# EasyEDA Pro project ProProject_IMUSensorNodes202312.epro, board 6_6_拼板20240123（带编号） (continued)
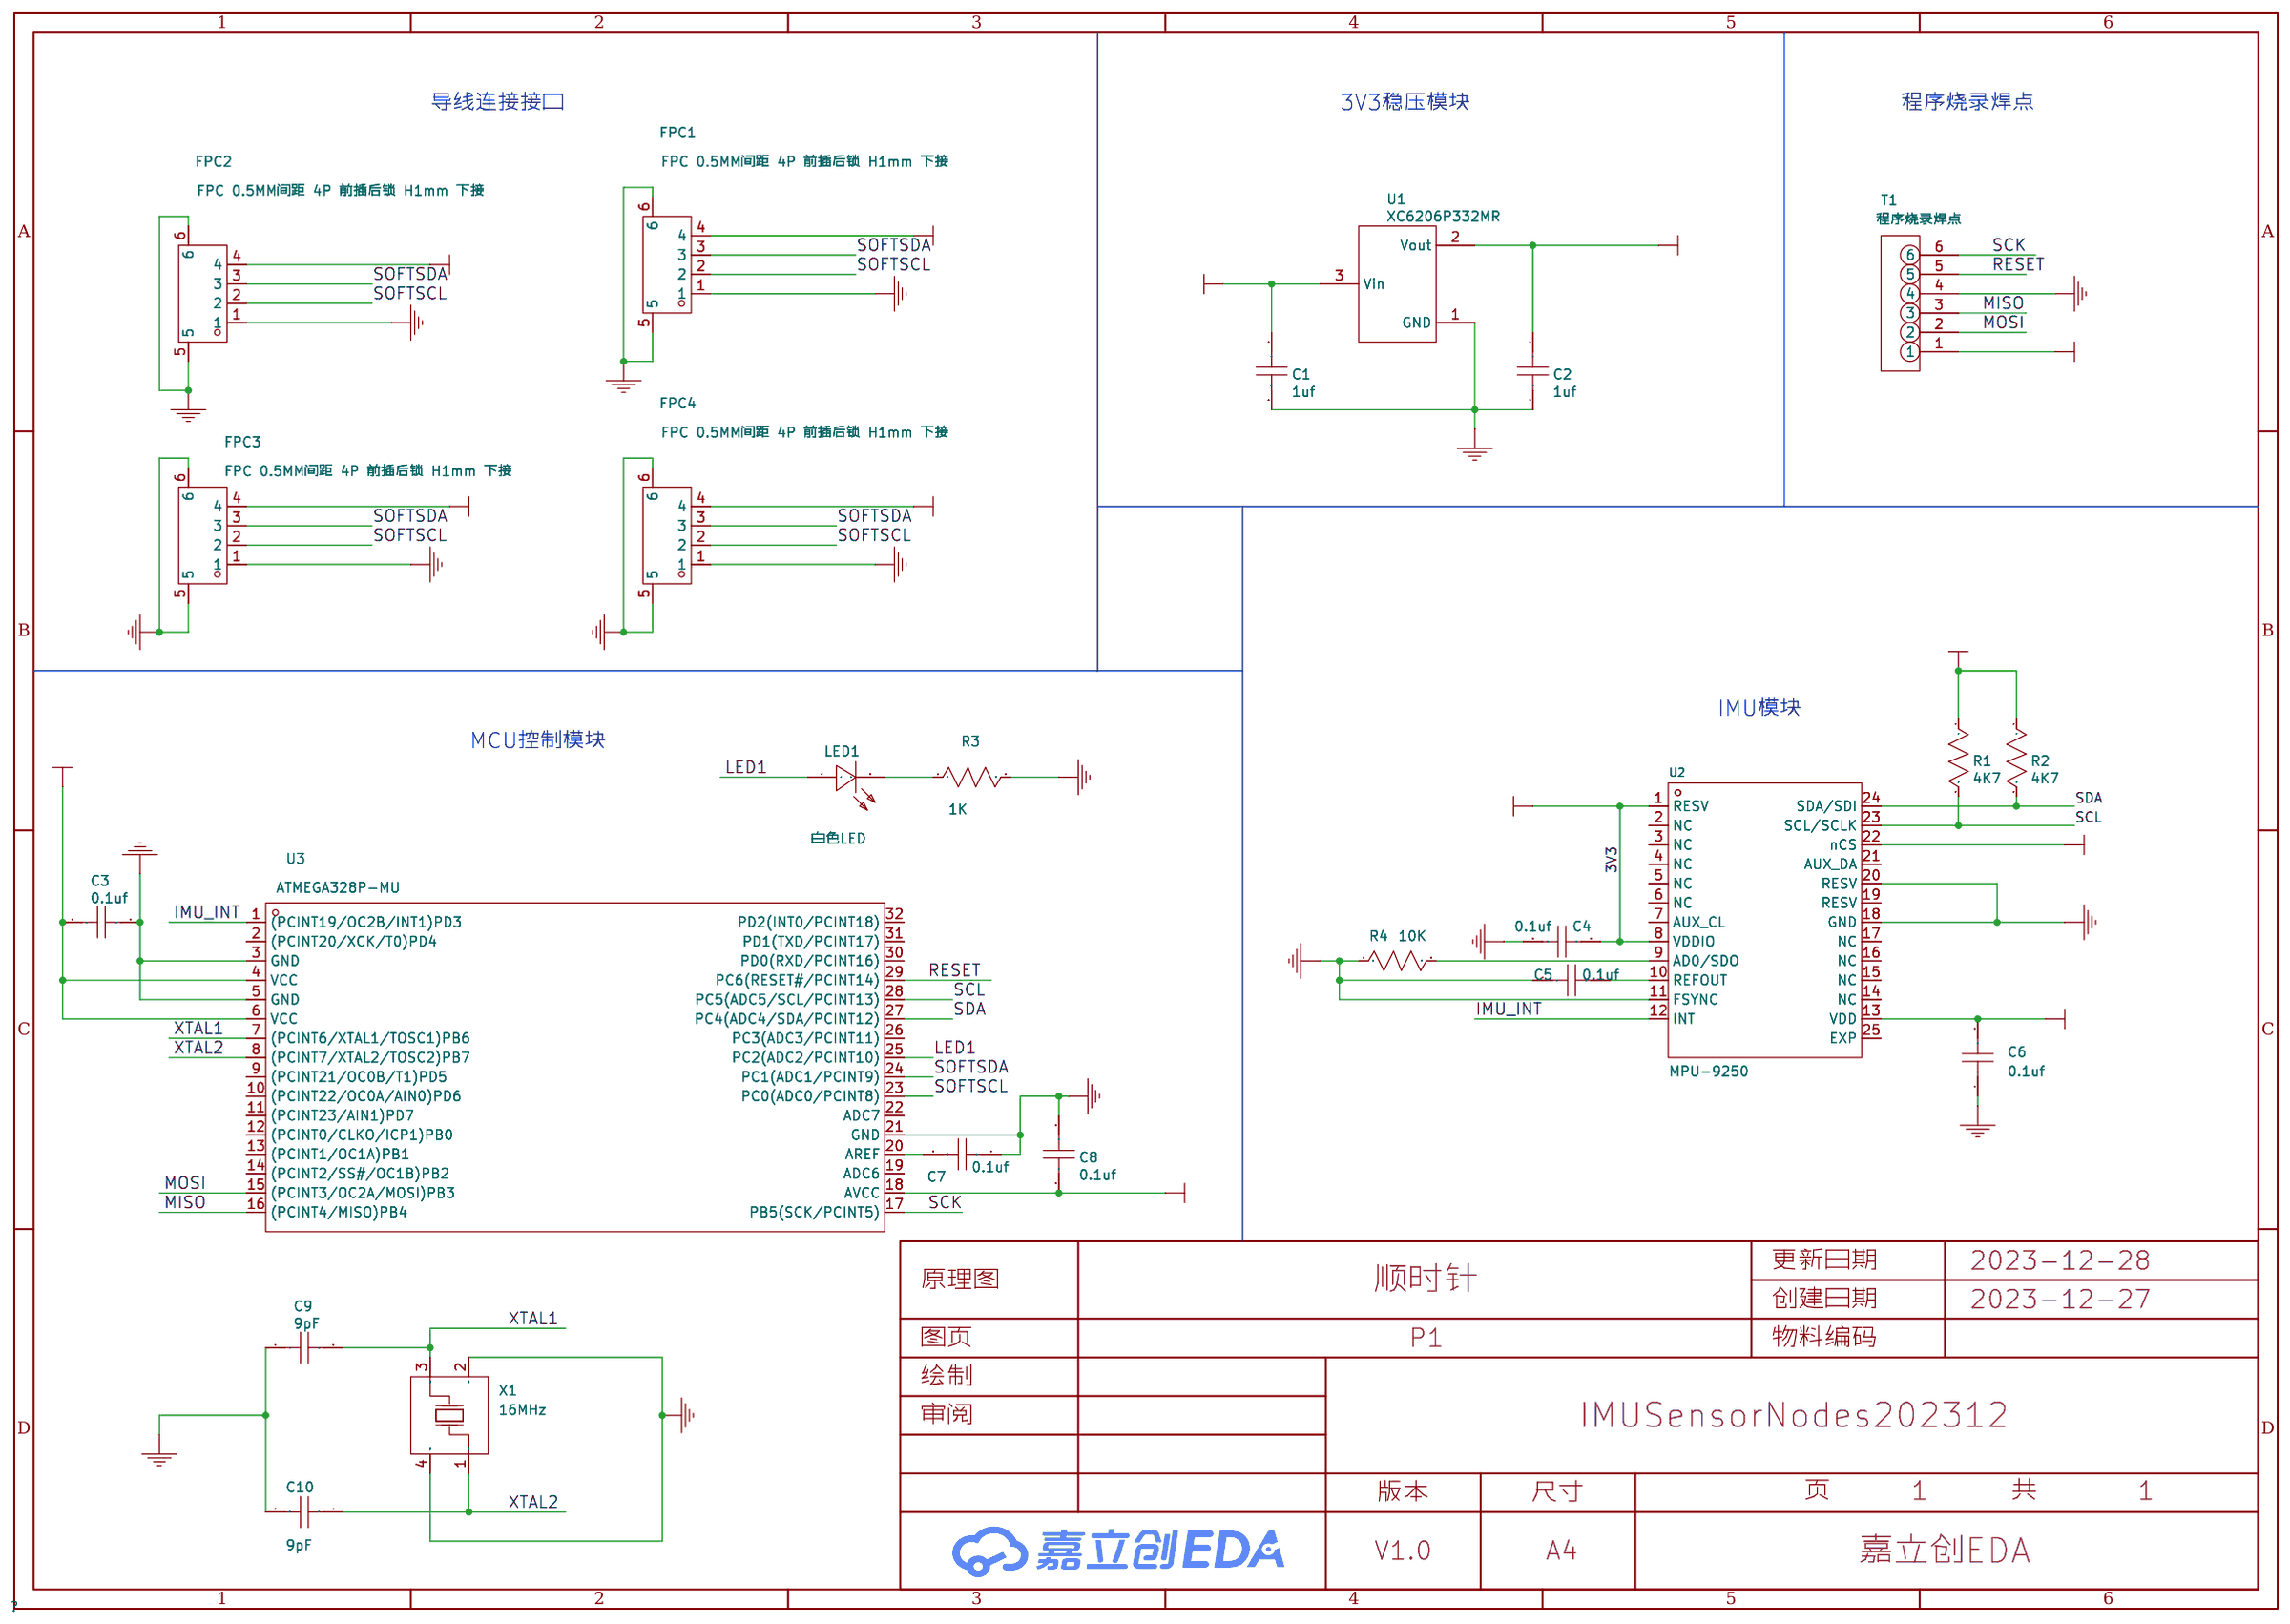
[diagram p0: schematic sheet]
## Placement (name value [footprint] x y rotation side) (continued)
Designator#913  -  [vqfn-32_l5.0-w5.0-p0.50-tl-ep3.1#2]  18.06 3.97 270 bottom
Designator#914  -  [test]  23.12 31.83 270 bottom
Designator#915  -  [qfn-24_l3.0-w3.0-p0.40-bl-ep]  18.32 64.29 0 bottom
Designator#916  -  [vqfn-32_l5.0-w5.0-p0.50-tl-ep3.1]  31.65 45.11 270 bottom
Designator#917  -  [vqfn-32_l5.0-w5.0-p0.50-tl-ep3.1]  4.35 3.97 270 bottom
Designator#918  -  [qfn-24_l3.0-w3.0-p0.40-bl-ep]  72.93 78.01 0 bottom
Designator#919  -  [qfn-24_l3.0-w3.0-p0.40-bl-ep#2]  59.21 36.86 0 bottom
Designator#920  -  [vqfn-32_l5.0-w5.0-p0.50-tl-ep3.1]  58.96 45.11 270 bottom
Designator#921  -  [qfn-24_l3.0-w3.0-p0.40-bl-ep#2]  31.91 36.86 0 bottom
Designator#922  -  [test]  23.12 18.11 270 bottom
Designator#923  -  [qfn-24_l3.0-w3.0-p0.40-bl-ep]  18.32 36.86 0 bottom
Designator#924  -  [test]  9.4 4.4 270 bottom

## Footprints (pads in the part's own frame, mm; a bottom-side part is the same pattern mirrored in y, then rotated)
C0201
  rect 0.28x0.318 smd: 1(-0.28,0) 2(0.28,0)
CRYSTAL-SMD_4P-L1.6-W1.2-BL
  rect 0.73x0.6 smd: 1(-0.55,-0.4) 2(0.55,-0.4) 3(0.55,0.4) 4(-0.55,0.4)
fpc-0.5mm-4p-h1.0
  rect 0.3x1 smd: 1(-0.75,0) 2(-0.251,0) 3(0.249,0) 4(0.75,0)
  rect 1x0.8 smd: 5(-1.81,-2.286)
  rect 1.2x0.8 smd: 6(1.794,-2.286)
fpc-0.5mm-4p-h1.0#2
  rect 0.3x1 smd: 1(-0.75,0) 2(-0.251,0) 3(0.249,0) 4(0.75,0)
  rect 1.2x0.8 smd: 5(-1.81,-2.286) 6(1.794,-2.286)
fpc-0.5mm-4p-h1.0#3
  rect 0.3x1 smd: 1(-0.75,0) 2(-0.251,0) 3(0.249,0) 4(0.75,0)
  rect 0.8x0.8 smd: 5(-1.81,-2.286) 6(1.794,-2.286)
LED0402
  rect 0.4x0.55 smd: 1(-0.45,0) 2(0.45,0)
qfn-24_l3.0-w3.0-p0.40-bl-ep
  custom 0.2x0.506 smd: 1(-1,-1.427) 6(1,-1.427) 13(1,1.427) 18(-1,1.427)
  rect 0.2x0.505 smd: 2(-0.6,-1.427) 3(-0.2,-1.427) 4(0.2,-1.427) 5(0.6,-1.427) 14(0.6,1.427) 15(0.2,1.427) 16(-0.2,1.427) 17(-0.6,1.427)
  rect 0.003x0.003 smd: 7(1.425,-0.997)
  rect 0.505x0.2 smd: 8(1.427,-0.6) 9(1.427,-0.2) 10(1.427,0.2) 11(1.427,0.6) 20(-1.427,0.6) 21(-1.427,0.2) 22(-1.427,-0.2) 23(-1.427,-0.6)
  custom 0.506x0.2 smd: 12(1.427,1) 19(-1.427,1) 24(-1.427,-1)
  rect 1.7x1.7 smd: 25(0,0)
qfn-24_l3.0-w3.0-p0.40-bl-ep#2
  custom 0.2x0.506 smd: 1(-1,-1.427) 6(1,-1.427) 13(1,1.427) 18(-1,1.427)
  rect 0.2x0.505 smd: 2(-0.6,-1.427) 3(-0.2,-1.427) 4(0.2,-1.427) 5(0.6,-1.427) 14(0.6,1.427) 15(0.2,1.427) 16(-0.2,1.427) 17(-0.6,1.427)
  rect 0.505x0.2 smd: 8(1.427,-0.6) 9(1.427,-0.2) 10(1.427,0.2) 11(1.427,0.6) 20(-1.427,0.6) 21(-1.427,0.2) 22(-1.427,-0.2) 23(-1.427,-0.6)
  custom 0.506x0.2 smd: 12(1.427,1) 19(-1.427,1) 24(-1.427,-1)
  rect 1.7x1.7 smd: 25(0,0)
R0201
  rect 0.28x0.318 smd: 1(-0.28,0) 2(0.28,0)
SOT-23-3_L2.9-W1.6-P1.90-LS2.8-BR
  rect 1.07x0.532 smd: 1(1.135,-0.95) 2(1.135,0.95) 3(-1.135,0)
test
  round 0.6 smd: 1(0,0) 2(1.27,0) 3(2.54,0) 4(0,-1.27) 5(1.27,-1.27) 6(2.54,-1.27)
vqfn-32_l5.0-w5.0-p0.50-tl-ep3.1
  rect 0.665x0.28 smd: 1(-2.408,1.75) 2(-2.408,1.25) 3(-2.408,0.75) 4(-2.408,0.25) 5(-2.408,-0.25) 6(-2.408,-0.75) 7(-2.408,-1.25) 8(-2.408,-1.75) 17(2.408,-1.75) 18(2.408,-1.25) 19(2.408,-0.75) 20(2.408,-0.25) 21(2.408,0.25) 23(2.408,1.25) 24(2.408,1.75)
  rect 0.28x0.665 smd: 10(-1.25,-2.408) 11(-0.75,-2.408) 12(-0.25,-2.408) 13(0.254,-2.413) 15(1.25,-2.408) 16(1.75,-2.408) 25(1.75,2.408) 27(0.75,2.408) 28(0.25,2.408) 29(-0.25,2.408) 32(-1.75,2.408)
  rect 0.003x0.003 smd: 13(0.25,-2.408)
  rect 3.1x3.1 smd: 33(0,0)
vqfn-32_l5.0-w5.0-p0.50-tl-ep3.1#2
  rect 0.665x0.28 smd: 1(-2.408,1.75) 2(-2.408,1.25) 3(-2.408,0.75) 4(-2.408,0.25) 5(-2.408,-0.25) 6(-2.408,-0.75) 7(-2.408,-1.25) 8(-2.408,-1.75) 17(2.408,-1.75) 18(2.408,-1.25) 19(2.408,-0.75) 20(2.408,-0.25) 21(2.408,0.25) 23(2.408,1.25) 24(2.408,1.75)
  rect 0.28x0.665 smd: 9(-1.75,-2.408) 10(-1.25,-2.408) 11(-0.75,-2.408) 12(-0.25,-2.408) 14(0.75,-2.408) 15(1.25,-2.408) 16(1.75,-2.408) 25(1.75,2.408) 27(0.75,2.408) 28(0.25,2.408) 29(-0.25,2.408) 31(-1.25,2.408) 32(-1.75,2.408)
  rect 3.1x3.1 smd: 33(0,0)
邮票孔
  round 0.3 hole 0.315x0.3: 1(0.508,2.54) 2(0.508,1.79) 3(0.508,1.04) 4(0.508,0.29) 5(0.508,-0.46) 6(0.508,-1.21) 7(0.508,-1.96) 8(0.508,-2.71) 9(-0.892,2.54) 10(-0.892,1.79) 11(-0.892,1.04) 12(-0.892,0.29) 13(-0.892,-0.46) 14(-0.892,-1.21) 15(-0.892,-1.96) 16(-0.892,-2.71)

## Nets
3V3: Designator#313.4 Designator#313.6 Designator#313.18 Designator#314.1 Designator#314.8 Designator#314.13 Designator#314.22 Designator#317.1 Designator#317.8 Designator#317.13 Designator#317.22 Designator#318.1 Designator#318.8 Designator#318.13 Designator#318.22 Designator#319.1 Designator#319.8 Designator#319.13 Designator#319.22 Designator#321.4 Designator#321.6 Designator#321.18 Designator#322.4 Designator#322.6 Designator#322.18 Designator#323.1 Designator#323.8 Designator#323.13 Designator#323.22 Designator#324.4 Designator#324.6 Designator#324.18 Designator#325.4 Designator#325.6 Designator#325.18 Designator#326.1 Designator#326.8 Designator#326.13 Designator#326.22 Designator#329.1 Designator#330.1 Designator#332.1 Designator#333.1 Designator#335.1 Designator#336.1 Designator#338.1 Designator#339.1 Designator#341.1 Designator#342.1 Designator#344.1 Designator#345.1 Designator#347.1 Designator#348.1 Designator#350.1 Designator#351.1 Designator#353.1 Designator#354.1 Designator#356.1 Designator#357.1 Designator#359.1 Designator#360.1 Designator#362.1 Designator#363.1 Designator#364.1 Designator#365.1 Designator#367.1 Designator#368.1 Designator#370.1 Designator#371.1 Designator#373.1 Designator#374.1 Designator#376.1 Designator#377.1 Designator#379.1 Designator#380.1 Designator#382.1 Designator#383.1 Designator#385.1 Designator#386.1 Designator#388.1 Designator#389.1 Designator#391.1 Designator#392.1 Designator#394.1 Designator#395.1 Designator#397.1 Designator#398.1 Designator#400.1 Designator#401.1 Designator#403.1 Designator#404.1 Designator#406.1 Designator#407.1 Designator#409.1 Designator#410.1 Designator#412.1 Designator#413.1 Designator#415.1 Designator#416.1 Designator#418.1 Designator#419.1 Designator#421.1 Designator#422.1 Designator#424.1 Designator#425.1 Designator#427.1 Designator#428.1 Designator#430.1 Designator#431.1 Designator#433.1 Designator#434.1 Designator#437.1 Designator#437.8 Designator#437.13 Designator#437.22 Designator#438.1 Designator#438.8 Designator#438.13 Designator#438.22 Designator#440.4 Designator#440.6 Designator#440.18 Designator#445.1 Designator#447.2 Designator#450.1 Designator#452.2 Designator#453.1 Designator#456.1 Designator#457.1 Designator#460.1 Designator#462.2 Designator#463.1 Designator#466.1 Designator#467.1 Designator#470.1 Designator#472.2 Designator#473.1 Designator#476.1 Designator#477.1 Designator#480.1 Designator#482.2 Designator#483.1 Designator#486.1 Designator#487.1 Designator#490.1 Designator#492.2 Designator#493.1 Designator#496.1 Designator#497.1 Designator#500.1 Designator#502.2 Designator#503.1 Designator#506.1 Designator#507.1 Designator#510.1 Designator#512.2 Designator#513.1 Designator#516.1 Designator#517.1 Designator#520.1 Designator#522.2 Designator#523.1 Designator#526.1 Designator#527.1 Designator#530.1 Designator#532.2 Designator#533.1 Designator#536.1 Designator#537.1 Designator#540.1 Designator#542.2 Designator#543.1 Designator#546.1 Designator#547.1 Designator#548.1 Designator#551.1 Designator#553.2 Designator#554.1 Designator#557.1 Designator#558.1 Designator#559.1 Designator#561.2 Designator#562.1 Designator#565.1 Designator#566.1 Designator#567.1 Designator#570.1 Designator#571.1 Designator#574.1 Designator#576.2 Designator#577.1 Designator#580.1 Designator#581.1 Designator#584.1 Designator#586.2 Designator#587.1 Designator#590.1 Designator#591.1 Designator#594.1 Designator#596.2 Designator#597.1 Designator#600.1 Designator#601.1 Designator#604.1 Designator#606.2 Designator#607.1 Designator#610.1 Designator#611.1 Designator#614.1 Designator#616.2 Designator#617.1 Designator#620.1 Designator#621.1 Designator#624.1 Designator#626.2 Designator#627.1 Designator#630.1 Designator#631.1 Designator#634.1 Designator#636.2 Designator#637.1 Designator#640.1 Designator#641.1 Designator#643.1 Designator#646.1 Designator#647.1 Designator#651.1 Designator#653.2 Designator#655.2 Designator#656.1 Designator#659.1 Designator#660.1 Designator#663.1 Designator#665.2 Designator#666.1 Designator#669.1 Designator#670.1 Designator#673.1 Designator#675.2 Designator#676.1 Designator#679.1 Designator#680.1 Designator#683.1 Designator#685.2 Designator#686.1 Designator#689.1 Designator#690.1 Designator#693.1 Designator#695.2 Designator#696.1 Designator#699.1 Designator#700.1 Designator#703.1 Designator#705.2 Designator#706.1 Designator#709.1 Designator#710.1 Designator#713.1 Designator#715.2 Designator#716.1 Designator#719.1 Designator#720.1 Designator#723.1 Designator#725.2 Designator#726.1 Designator#729.1 Designator#730.1 Designator#733.1 Designator#735.2 Designator#736.1 Designator#739.1 Designator#740.1 Designator#743.1 Designator#745.2 Designator#746.1 Designator#749.1 Designator#750.1 Designator#753.1 Designator#755.2 Designator#756.1 Designator#759.1 Designator#760.1 Designator#763.1 Designator#765.2 Designator#766.1 Designator#769.1 Designator#770.1 Designator#773.1 Designator#775.2 Designator#776.1 Designator#779.1 Designator#780.1 Designator#783.1 Designator#785.2 Designator#786.1 Designator#789.1 Designator#790.1 Designator#793.1 Designator#795.2 Designator#796.1 Designator#799.1 Designator#800.1 Designator#801.4 Designator#801.6 Designator#801.18 Designator#803.4 Designator#803.6 Designator#803.18 Designator#806.4 Designator#806.6 Designator#806.18 Designator#808.4 Designator#808.6 Designator#808.18 Designator#809.4 Designator#809.6 Designator#809.18 Designator#810.4 Designator#810.6 Designator#810.18 Designator#811.4 Designator#811.6 Designator#811.18 Designator#813.1 Designator#813.8 Designator#813.13 Designator#813.22 Designator#814.1 Designator#814.8 Designator#814.13 Designator#814.22 Designator#818.1 Designator#818.8 Designator#818.13 Designator#818.22 Designator#819.1 Designator#819.8 Designator#819.13 Designator#819.22 Designator#820.4 Designator#820.6 Designator#820.18 Designator#822.4 Designator#822.6 Designator#822.18 Designator#826.1 Designator#826.8 Designator#826.13 Designator#826.22 Designator#827.4 Designator#827.6 Designator#827.18 Designator#829.4 Designator#829.6 Designator#829.18 Designator#830.1 Designator#830.8 Designator#830.13 Designator#830.22 Designator#831.1 Designator#831.8 Designator#831.13 Designator#831.22 Designator#832.4 Designator#832.6 Designator#832.18 Designator#835.4 Designator#835.6 Designator#835.18 Designator#836.1 Designator#836.8 Designator#836.13 Designator#836.22 Designator#837.4 Designator#837.6 Designator#837.18 Designator#838.4 Designator#838.6 Designator#838.18 Designator#839.4 Designator#839.6 Designator#839.18 Designator#840.2 Designator#841.2 Designator#842.2 Designator#843.2 Designator#844.2 Designator#845.2 Designator#846.2 Designator#847.2 Designator#848.2 Designator#849.2 Designator#850.2 Designator#851.2 Designator#852.2 Designator#853.2 Designator#854.2 Designator#855.2 Designator#856.2 Designator#857.2 Designator#858.2 Designator#859.2 Designator#860.2 Designator#861.2 Designator#862.2 Designator#863.2 Designator#864.2 Designator#865.2 Designator#866.2 Designator#867.2 Designator#868.2 Designator#869.2 Designator#870.2 Designator#871.2 Designator#872.2 Designator#873.2 Designator#874.2 Designator#875.2 Designator#877.1 Designator#877.8 Designator#877.13 Designator#877.22 Designator#878.1 Designator#878.8 Designator#878.13 Designator#878.22 Designator#880.1 Designator#880.8 Designator#880.13 Designator#880.22 Designator#881.1 Designator#881.8 Designator#881.13 Designator#881.22 Designator#882.1 Designator#882.8 Designator#882.13 Designator#882.22 Designator#883.1 Designator#883.8 Designator#883.13 Designator#883.22 Designator#885.4 Designator#885.6 Designator#885.18 Designator#886.1 Designator#886.8 Designator#886.13 Designator#886.22 Designator#888.1 Designator#888.8 Designator#888.13 Designator#888.22 Designator#889.4 Designator#889.6 Designator#889.18 Designator#890.1 Designator#890.8 Designator#890.13 Designator#890.22 Designator#892.4 Designator#892.6 Designator#892.18 Designator#895.4 Designator#895.6 Designator#895.18 Designator#896.4 Designator#896.6 Designator#896.18 Designator#897.1 Designator#897.8 Designator#897.13 Designator#897.22 Designator#900.1 Designator#900.8 Designator#900.13 Designator#900.22 Designator#901.1 Designator#901.8 Designator#901.13 Designator#901.22 Designator#902.4 Designator#902.6 Designator#902.18 Designator#903.4 Designator#903.6 Designator#903.18 Designator#904.4 Designator#904.6 Designator#904.18 Designator#906.4 Designator#906.6 Designator#906.18 Designator#909.1 Designator#909.8 Designator#909.13 Designator#909.22 Designator#910.4 Designator#910.6 Designator#910.18 Designator#911.1 Designator#911.8 Designator#911.13 Designator#911.22 Designator#912.1 Designator#912.8 Designator#912.13 Designator#912.22 Designator#913.4 Designator#913.6 Designator#913.18 Designator#915.1 Designator#915.8 Designator#915.13 Designator#915.22 Designator#916.4 Designator#916.6 Designator#916.18 Designator#917.4 Designator#917.6 Designator#917.18 Designator#918.1 Designator#918.8 Designator#918.13 Designator#918.22 Designator#919.1 Designator#919.8 Designator#919.13 Designator#919.22 Designator#920.4 Designator#920.6 Designator#920.18 Designator#921.1 Designator#921.8 Designator#921.13 Designator#921.22 Designator#923.1 Designator#923.8 Designator#923.13 Designator#923.22
5V: Designator.4 Designator#2.1 Designator#3.4 Designator#4.1 Designator#5.4 Designator#6.4 Designator#7.4 Designator#8.4 Designator#9.1 Designator#10.4 Designator#11.4 Designator#12.1 Designator#13.1 Designator#14.4 Designator#15.4 Designator#16.4 Designator#17.1 Designator#18.4 Designator#19.1 Designator#20.1 Designator#81.1 Designator#82.1 Designator#83.1 Designator#84.1 Designator#85.4 Designator#86.4 Designator#87.1 Designator#88.4 Designator#89.1 Designator#90.1 Designator#91.1 Designator#92.4 Designator#93.4 Designator#94.4 Designator#95.1 Designator#96.4 Designator#97.1 Designator#98.4 Designator#99.4 Designator#100.1 Designator#101.4 Designator#102.1 Designator#103.1 Designator#104.1 Designator#105.4 Designator#106.1 Designator#107.4 Designator#108.1 Designator#109.1 Designator#146.1 Designator#147.1 Designator#148.4 Designator#149.1 Designator#150.4 Designator#151.4 Designator#152.1 Designator#153.1 Designator#154.1 Designator#155.1 Designator#156.4 Designator#157.4 Designator#158.1 Designator#159.4 Designator#160.1 Designator#161.4 Designator#162.1 Designator#163.4 Designator#164.1 Designator#165.1 Designator#166.4 Designator#167.1 Designator#168.1 Designator#169.4 Designator#170.1 Designator#171.1 Designator#172.1 Designator#173.1 Designator#174.1 Designator#175.4 Designator#176.1 Designator#177.1 Designator#214.4 Designator#215.4 Designator#216.1 Designator#217.4 Designator#218.4 Designator#219.4 Designator#220.1 Designator#221.4 Designator#222.4 Designator#223.4 Designator#224.4 Designator#225.4 Designator#226.1 Designator#227.1 Designator#228.1 Designator#229.1 Designator#230.4 Designator#231.4 Designator#232.1 Designator#233.4 Designator#234.4 Designator#235.1 Designator#236.4 Designator#237.4 Designator#238.4 Designator#239.4 Designator#240.4 Designator#241.1 Designator#242.1 Designator#243.4 Designator#244.1 Designator#245.1 Designator#282.1 Designator#283.4 Designator#284.1 Designator#285.1 Designator#286.1 Designator#287.1 Designator#288.1 Designator#289.1 Designator#290.4 Designator#291.4 Designator#292.4 Designator#293.4 Designator#294.4 Designator#295.1 Designator#296.1 Designator#297.4 Designator#298.4 Designator#299.4 Designator#300.4 Designator#301.4 Designator#302.4 Designator#303.4 Designator#304.1 Designator#305.1 Designator#306.1 Designator#307.1 Designator#308.4 Designator#309.4 Designator#310.1 Designator#311.4 Designator#312.4 Designator#315.1 Designator#316.1 Designator#320.1 Designator#327.1 Designator#436.1 Designator#439.1 Designator#454.1 Designator#464.1 Designator#474.1 Designator#484.1 Designator#494.1 Designator#504.1 Designator#514.1 Designator#524.1 Designator#534.1 Designator#544.1 Designator#555.1 Designator#563.1 Designator#568.1 Designator#578.1 Designator#588.1 Designator#598.1 Designator#608.1 Designator#618.1 Designator#628.1 Designator#638.1 Designator#644.1 Designator#657.1 Designator#667.1 Designator#677.1 Designator#687.1 Designator#697.1 Designator#707.1 Designator#717.1 Designator#727.1 Designator#737.1 Designator#747.1 Designator#757.1 Designator#767.1 Designator#777.1 Designator#787.1 Designator#797.1 Designator#802.1 Designator#804.1 Designator#805.1 Designator#807.1 Designator#812.1 Designator#815.1 Designator#816.1 Designator#817.1 Designator#821.1 Designator#823.1 Designator#824.1 Designator#825.1 Designator#828.1 Designator#833.1 Designator#834.1 Designator#840.3 Designator#841.3 Designator#842.3 Designator#843.3 Designator#844.3 Designator#845.3 Designator#846.3 Designator#847.3 Designator#848.3 Designator#849.3 Designator#850.3 Designator#851.3 Designator#852.3 Designator#853.3 Designator#854.3 Designator#855.3 Designator#856.3 Designator#857.3 Designator#858.3 Designator#859.3 Designator#860.3 Designator#861.3 Designator#862.3 Designator#863.3 Designator#864.3 Designator#865.3 Designator#866.3 Designator#867.3 Designator#868.3 Designator#869.3 Designator#870.3 Designator#871.3 Designator#872.3 Designator#873.3 Designator#874.3 Designator#875.3 Designator#876.1 Designator#879.1 Designator#884.1 Designator#887.1 Designator#891.1 Designator#893.1 Designator#894.1 Designator#898.1 Designator#899.1 Designator#905.1 Designator#907.1 Designator#908.1 Designator#914.1 Designator#922.1 Designator#924.1
GND: Designator.1 Designator.5 Designator.6 Designator#2.4 Designator#2.5 Designator#2.6 Designator#3.1 Designator#3.5 Designator#3.6 Designator#4.4 Designator#4.5 Designator#4.6 Designator#5.1 Designator#5.5 Designator#5.6 Designator#6.1 Designator#6.5 Designator#6.6 Designator#7.1 Designator#8.1 Designator#9.4 Designator#9.5 Designator#9.6 Designator#10.1 Designator#11.1 Designator#11.5 Designator#11.6 Designator#12.4 Designator#12.5 Designator#12.6 Designator#13.4 Designator#13.5 Designator#13.6 Designator#14.1 Designator#14.5 Designator#14.6 Designator#15.1 Designator#15.5 Designator#15.6 Designator#16.1 Designator#17.4 Designator#17.5 Designator#17.6 Designator#18.1 Designator#18.5 Designator#18.6 Designator#19.4 Designator#20.4 Designator#20.5 Designator#20.6 Designator#81.4 Designator#81.5 Designator#81.6 Designator#82.4 Designator#82.5 Designator#82.6 Designator#83.4 Designator#83.5 Designator#83.6 Designator#84.4 Designator#84.5 Designator#84.6 Designator#85.1 Designator#86.1 Designator#86.5 Designator#86.6 Designator#87.4 Designator#87.5 Designator#87.6 Designator#88.1 Designator#89.4 Designator#90.4 Designator#91.4 Designator#91.5 Designator#91.6 Designator#92.1 Designator#92.5 Designator#92.6 Designator#93.1 Designator#93.5 Designator#93.6 Designator#94.1 Designator#94.5 Designator#94.6 Designator#95.4 Designator#95.5 Designator#95.6 Designator#96.1 Designator#97.4 Designator#97.5 Designator#97.6 Designator#98.1 Designator#98.5 Designator#98.6 Designator#99.1 Designator#99.5 Designator#99.6 Designator#100.4 Designator#100.5 Designator#100.6 Designator#101.1 Designator#102.4 Designator#103.4 Designator#103.5 Designator#103.6 Designator#104.4 Designator#104.5 Designator#104.6 Designator#105.1 Designator#106.4 Designator#106.5 Designator#106.6 Designator#107.1 Designator#108.4 Designator#109.4 Designator#109.5 Designator#109.6 Designator#110.2 Designator#110.4 Designator#111.2 Designator#111.4 Designator#112.2 Designator#112.4 Designator#113.2 Designator#113.4 Designator#114.2 Designator#114.4 Designator#115.2 Designator#115.4 Designator#116.2 Designator#116.4 Designator#117.2 Designator#117.4 Designator#118.2 Designator#118.4 Designator#119.2 Designator#119.4 Designator#120.2 Designator#120.4 Designator#121.2 Designator#121.4 Designator#122.2 Designator#122.4 Designator#123.2 Designator#123.4 Designator#124.2 Designator#124.4 Designator#125.2 Designator#125.4 Designator#126.2 Designator#126.4 Designator#127.2 Designator#127.4 Designator#128.2 Designator#128.4 Designator#129.2 Designator#129.4 Designator#130.2 Designator#130.4 Designator#131.2 Designator#131.4 Designator#132.2 Designator#132.4 Designator#133.2 Designator#133.4 Designator#134.2 Designator#134.4 Designator#135.2 Designator#135.4 Designator#136.2 Designator#136.4 Designator#137.2 Designator#137.4 Designator#138.2 Designator#138.4 Designator#139.2 Designator#139.4 Designator#140.2 Designator#140.4 Designator#141.2 Designator#141.4 Designator#142.2 Designator#142.4 Designator#143.2 Designator#143.4 Designator#144.2 Designator#144.4 Designator#145.2 Designator#145.4 Designator#146.4 Designator#146.5 Designator#146.6 Designator#147.4 Designator#147.5 Designator#147.6 Designator#148.1 Designator#148.5 Designator#148.6 Designator#149.4 Designator#150.1 Designator#150.5 Designator#150.6 Designator#151.1 Designator#151.5 Designator#151.6 Designator#152.4 Designator#152.5 Designator#152.6 Designator#153.4 Designator#154.4 Designator#155.4 Designator#155.5 Designator#155.6 Designator#156.1 Designator#156.5 Designator#156.6 Designator#157.1 Designator#157.5 Designator#157.6 Designator#158.4 Designator#158.5 Designator#158.6 Designator#159.1 Designator#159.5 Designator#159.6 Designator#160.4 Designator#160.5 Designator#160.6 Designator#161.1 Designator#162.4 Designator#162.5 Designator#162.6 Designator#163.1 Designator#164.4 Designator#164.5 Designator#164.6 Designator#165.4 Designator#165.5 Designator#165.6 Designator#166.1 Designator#166.5 Designator#166.6 Designator#167.4 Designator#167.5 Designator#167.6 Designator#168.4 Designator#168.5 Designator#168.6 Designator#169.1 Designator#169.5 Designator#169.6 Designator#170.4 Designator#170.5 Designator#170.6 Designator#171.4 Designator#171.5 Designator#171.6 Designator#172.4 Designator#173.4 Designator#173.5 Designator#173.6 Designator#174.4 Designator#175.1 Designator#175.5 Designator#175.6 Designator#176.4 Designator#176.5 Designator#176.6 Designator#177.4 Designator#178.2 Designator#179.2 Designator#180.2 Designator#181.2 Designator#182.2 Designator#183.2 Designator#184.2 Designator#185.2 Designator#186.2 Designator#187.2 Designator#188.2 Designator#189.2 Designator#190.2 Designator#191.2 Designator#192.2 Designator#193.2 Designator#194.2 Designator#195.2 Designator#196.2 Designator#197.2 Designator#198.2 Designator#199.2 Designator#200.2 Designator#201.2 Designator#202.2 Designator#203.2 Designator#204.2 Designator#205.2 Designator#206.2 Designator#207.2 Designator#208.2 Designator#209.2 Designator#210.2 Designator#211.2 Designator#212.2 Designator#213.2 Designator#214.1 Designator#214.5 Designator#214.6 Designator#215.1 Designator#215.5 Designator#215.6 Designator#216.4 Designator#217.1 Designator#217.5 Designator#217.6 Designator#218.1 Designator#218.5 Designator#218.6 Designator#219.1 Designator#219.5 Designator#219.6 Designator#220.4 Designator#220.5 Designator#220.6 Designator#221.1 Designator#221.5 Designator#221.6 Designator#222.1 Designator#223.1 Designator#224.1 Designator#225.1 Designator#225.5 Designator#225.6 Designator#226.4 Designator#226.5 Designator#226.6 Designator#227.4 Designator#228.4 Designator#228.5 Designator#228.6 Designator#229.4 Designator#229.5 Designator#229.6 Designator#230.1 Designator#230.5 Designator#230.6 Designator#231.1 Designator#231.5 Designator#231.6 Designator#232.4 Designator#232.5 Designator#232.6 Designator#233.1 Designator#233.5 Designator#233.6 Designator#234.1 Designator#234.5 Designator#234.6 Designator#235.4 Designator#235.5 Designator#235.6 Designator#236.1 Designator#237.1 Designator#237.5 Designator#237.6 Designator#238.1 Designator#238.5 Designator#238.6 Designator#239.1 Designator#239.5 Designator#239.6 Designator#240.1 Designator#241.4 Designator#241.5 Designator#241.6 Designator#242.4 Designator#243.1 Designator#243.5 Designator#243.6 Designator#244.4 Designator#244.5 Designator#244.6 Designator#245.4 Designator#282.4 Designator#282.5 Designator#282.6 Designator#283.1 Designator#283.5 Designator#283.6 Designator#284.4 Designator#284.5 Designator#284.6 Designator#285.4 Designator#286.4 Designator#286.5 Designator#286.6 Designator#287.4 Designator#287.5 Designator#287.6 Designator#288.4 Designator#288.5 Designator#288.6 Designator#289.4 Designator#289.5 Designator#289.6 Designator#290.1 Designator#290.5 Designator#290.6 Designator#291.1 Designator#291.5 Designator#291.6 Designator#292.1 Designator#292.5 Designator#292.6 Designator#293.1 Designator#294.1 Designator#294.5 Designator#294.6 Designator#295.4 Designator#296.4 Designator#296.5 Designator#296.6 Designator#297.1 Designator#297.5 Designator#297.6 Designator#298.1 Designator#298.5 Designator#298.6 Designator#299.1 Designator#299.5 Designator#299.6 Designator#300.1 Designator#300.5 Designator#300.6 Designator#301.1 Designator#301.5 Designator#301.6 Designator#302.1 Designator#302.5 Designator#302.6 Designator#303.1 Designator#303.5 Designator#303.6 Designator#304.4 Designator#304.5 Designator#304.6 Designator#305.4 Designator#305.5 Designator#305.6 Designator#306.4 Designator#307.4 Designator#307.5 Designator#307.6 Designator#308.1 Designator#308.5 Designator#308.6 Designator#309.1 Designator#309.5 Designator#309.6 Designator#310.4 Designator#310.5 Designator#310.6 Designator#311.1 Designator#311.5 Designator#311.6 Designator#312.1 Designator#312.5 Designator#312.6 Designator#313.3 Designator#313.5 Designator#313.21 Designator#313.33 Designator#314.11 Designator#314.18 Designator#314.20 Designator#314.25 Designator#315.4 Designator#316.4 Designator#317.11 Designator#317.18 Designator#317.20 Designator#317.25 Designator#318.11 Designator#318.18 Designator#318.20 Designator#318.25 Designator#319.11 Designator#319.18 Designator#319.20 Designator#319.25 Designator#320.4 Designator#321.3 Designator#321.5 Designator#321.21 Designator#321.33 Designator#322.3 Designator#322.5 Designator#322.21 Designator#322.33 Designator#323.11 Designator#323.18 Designator#323.20 Designator#323.25 Designator#324.3 Designator#324.5 Designator#324.21 Designator#324.33 Designator#325.3 Designator#325.5 Designator#325.21 Designator#325.33 Designator#326.11 Designator#326.18 Designator#326.20 Designator#326.25 Designator#327.4 Designator#328.1 Designator#331.1 Designator#334.1 Designator#337.1 Designator#340.1 Designator#343.1 Designator#346.1 Designator#349.1 Designator#352.1 Designator#355.1 Designator#358.1 Designator#361.1 Designator#366.1 Designator#369.1 Designator#372.1 Designator#375.1 Designator#378.1 Designator#381.1 Designator#384.1 Designator#387.1 Designator#390.1 Designator#393.1 Designator#396.1 Designator#399.1 Designator#402.1 Designator#405.1 Designator#408.1 Designator#411.1 Designator#414.1 Designator#417.1 Designator#420.1 Designator#423.1 Designator#426.1 Designator#429.1 Designator#432.1 Designator#435.1 Designator#436.4 Designator#437.11 Designator#437.18 Designator#437.20 Designator#437.25 Designator#438.11 Designator#438.18 Designator#438.20 Designator#438.25 Designator#439.4 Designator#440.3 Designator#440.5 Designator#440.21 Designator#440.33 Designator#441.2 Designator#442.1 Designator#443.2 Designator#444.1 Designator#445.2 Designator#446.1 Designator#447.1 Designator#448.2 Designator#449.1 Designator#450.2 Designator#451.1 Designator#452.1 Designator#453.2 Designator#454.2 Designator#455.1 Designator#456.2 Designator#457.2 Designator#458.2 Designator#459.1 Designator#460.2 Designator#461.1 Designator#462.1 Designator#463.2 Designator#464.2 Designator#465.1 Designator#466.2 Designator#467.2 Designator#468.2 Designator#469.1 Designator#470.2 Designator#471.1 Designator#472.1 Designator#473.2 Designator#474.2 Designator#475.1 Designator#476.2 Designator#477.2 Designator#478.2 Designator#479.1 Designator#480.2 Designator#481.1 Designator#482.1 Designator#483.2 Designator#484.2 Designator#485.1 Designator#486.2 Designator#487.2 Designator#488.2 Designator#489.1 Designator#490.2 Designator#491.1 Designator#492.1 Designator#493.2 Designator#494.2 Designator#495.1 Designator#496.2 Designator#497.2 Designator#498.2 Designator#499.1 Designator#500.2 Designator#501.1 Designator#502.1 Designator#503.2 Designator#504.2 Designator#505.1 Designator#506.2 Designator#507.2 Designator#508.2 Designator#509.1 Designator#510.2 Designator#511.1 Designator#512.1 Designator#513.2 Designator#514.2 Designator#515.1 Designator#516.2 Designator#517.2 Designator#518.2 Designator#519.1 Designator#520.2 Designator#521.1 Designator#522.1 Designator#523.2 Designator#524.2 Designator#525.1 Designator#526.2 Designator#527.2 Designator#528.2 Designator#529.1 Designator#530.2 Designator#531.1 Designator#532.1 Designator#533.2 Designator#534.2 Designator#535.1 Designator#536.2 Designator#537.2 Designator#538.2 Designator#539.1 Designator#540.2 Designator#541.1 Designator#542.1 Designator#543.2 Designator#544.2 Designator#545.1 Designator#546.2 Designator#547.2 Designator#548.2 Designator#549.2 Designator#550.1 Designator#551.2 Designator#552.1 Designator#553.1 Designator#554.2 Designator#555.2 Designator#556.1 Designator#557.2 Designator#558.2 Designator#559.2 Designator#560.1 Designator#561.1 Designator#562.2 Designator#563.2 Designator#564.1 Designator#565.2 Designator#566.2 Designator#567.2 Designator#568.2 Designator#569.1 Designator#570.2 Designator#571.2 Designator#572.2 Designator#573.1 Designator#574.2 Designator#575.1 Designator#576.1 Designator#577.2 Designator#578.2 Designator#579.1 Designator#580.2 Designator#581.2 Designator#582.2 Designator#583.1 Designator#584.2 Designator#585.1 Designator#586.1 Designator#587.2 Designator#588.2 Designator#589.1 Designator#590.2 Designator#591.2 Designator#592.2 Designator#593.1 Designator#594.2 Designator#595.1 Designator#596.1 Designator#597.2 Designator#598.2 Designator#599.1 Designator#600.2 Designator#601.2 Designator#602.2 Designator#603.1 Designator#604.2 Designator#605.1 Designator#606.1 Designator#607.2 Designator#608.2 Designator#609.1 Designator#610.2 Designator#611.2 Designator#612.2 Designator#613.1 Designator#614.2 Designator#615.1 Designator#616.1 Designator#617.2 Designator#618.2 Designator#619.1 Designator#620.2 Designator#621.2 Designator#622.2 Designator#623.1 Designator#624.2 Designator#625.1 Designator#626.1 Designator#627.2 Designator#628.2 Designator#629.1 Designator#630.2 Designator#631.2 Designator#632.2 Designator#633.1 Designator#634.2 Designator#635.1 Designator#636.1 Designator#637.2 Designator#638.2 Designator#639.1 Designator#640.2 Designator#641.2 Designator#642.2 Designator#643.2 Designator#644.2 Designator#645.1 Designator#646.2 Designator#647.2 Designator#648.1 Designator#649.2 Designator#650.1 Designator#651.2 Designator#652.1 Designator#653.1 Designator#654.1 Designator#655.1 Designator#656.2 Designator#657.2 Designator#658.1 Designator#659.2 Designator#660.2 Designator#661.2 Designator#662.1 Designator#663.2 Designator#664.1 Designator#665.1 Designator#666.2 Designator#667.2 Designator#668.1 Designator#669.2 Designator#670.2 Designator#671.2 Designator#672.1 Designator#673.2 Designator#674.1 Designator#675.1 Designator#676.2 Designator#677.2 Designator#678.1 Designator#679.2 Designator#680.2 Designator#681.2 Designator#682.1 Designator#683.2 Designator#684.1 Designator#685.1 Designator#686.2 Designator#687.2 Designator#688.1 Designator#689.2 Designator#690.2 Designator#691.2 Designator#692.1 Designator#693.2 Designator#694.1 Designator#695.1 Designator#696.2 Designator#697.2 Designator#698.1 Designator#699.2 Designator#700.2 Designator#701.2 Designator#702.1 Designator#703.2 Designator#704.1 Designator#705.1 Designator#706.2 Designator#707.2 Designator#708.1 Designator#709.2 Designator#710.2 Designator#711.2 Designator#712.1 Designator#713.2 Designator#714.1 Designator#715.1 Designator#716.2 Designator#717.2 Designator#718.1 Designator#719.2 Designator#720.2 Designator#721.2 Designator#722.1 Designator#723.2 Designator#724.1 Designator#725.1 Designator#726.2 Designator#727.2 Designator#728.1 Designator#729.2 Designator#730.2 Designator#731.2 Designator#732.1 Designator#733.2 Designator#734.1 Designator#735.1 Designator#736.2 Designator#737.2 Designator#738.1 Designator#739.2 Designator#740.2 Designator#741.2 Designator#742.1 Designator#743.2 Designator#744.1 Designator#745.1 Designator#746.2 Designator#747.2 Designator#748.1 Designator#749.2 Designator#750.2 Designator#751.2 Designator#752.1 Designator#753.2 Designator#754.1 Designator#755.1 Designator#756.2 Designator#757.2 Designator#758.1 Designator#759.2 Designator#760.2 Designator#761.2 Designator#762.1 Designator#763.2 Designator#764.1 Designator#765.1 Designator#766.2 Designator#767.2 Designator#768.1 Designator#769.2 Designator#770.2 Designator#771.2 Designator#772.1 Designator#773.2 Designator#774.1 Designator#775.1 Designator#776.2 Designator#777.2 Designator#778.1 Designator#779.2 Designator#780.2 Designator#781.2 Designator#782.1 Designator#783.2 Designator#784.1 Designator#785.1 Designator#786.2 Designator#787.2 Designator#788.1 Designator#789.2 Designator#790.2 Designator#791.2 Designator#792.1 Designator#793.2 Designator#794.1 Designator#795.1 Designator#796.2 Designator#797.2 Designator#798.1 Designator#799.2 Designator#800.2 Designator#801.3 Designator#801.5 Designator#801.21 Designator#801.33 Designator#802.4 Designator#803.3 Designator#803.5 Designator#803.21 Designator#803.33 Designator#804.4 Designator#805.4 Designator#806.3 Designator#806.5 Designator#806.21 Designator#806.33 Designator#807.4 Designator#808.3 Designator#808.5 Designator#808.21 Designator#808.33 Designator#809.3 Designator#809.5 Designator#809.21 Designator#809.33 Designator#810.3 Designator#810.5 Designator#810.21 Designator#810.33 Designator#811.3 Designator#811.5 Designator#811.21 Designator#811.33 Designator#812.4 Designator#813.11 Designator#813.18 Designator#813.20 Designator#813.25 Designator#814.11 Designator#814.18 Designator#814.20 Designator#814.25 Designator#815.4 Designator#816.4 Designator#817.4 Designator#818.11 Designator#818.18 Designator#818.20 Designator#818.25 Designator#819.11 Designator#819.18 Designator#819.20 Designator#819.25 Designator#820.3 Designator#820.5 Designator#820.21 Designator#820.33 Designator#821.4 Designator#822.3 Designator#822.5 Designator#822.21 Designator#822.33 Designator#823.4 Designator#824.4 Designator#825.4 Designator#826.11 Designator#826.18 Designator#826.20 Designator#826.25 Designator#827.3 Designator#827.5 Designator#827.21 Designator#827.33 Designator#828.4 Designator#829.3 Designator#829.5 Designator#829.21 Designator#829.33 Designator#830.11 Designator#830.18 Designator#830.20 Designator#830.25 Designator#831.11 Designator#831.18 Designator#831.20 Designator#831.25 Designator#832.3 Designator#832.5 Designator#832.21 Designator#832.33 Designator#833.4 Designator#834.4 Designator#835.3 Designator#835.5 Designator#835.21 Designator#835.33 Designator#836.11 Designator#836.18 Designator#836.20 Designator#836.25 Designator#837.3 Designator#837.5 Designator#837.21 Designator#837.33 Designator#838.3 Designator#838.5 Designator#838.21 Designator#838.33 Designator#839.3 Designator#839.5 Designator#839.21 Designator#839.33 Designator#840.1 Designator#841.1 Designator#842.1 Designator#843.1 Designator#844.1 Designator#845.1 Designator#846.1 Designator#847.1 Designator#848.1 Designator#849.1 Designator#850.1 Designator#851.1 Designator#852.1 Designator#853.1 Designator#854.1 Designator#855.1 Designator#856.1 Designator#857.1 Designator#858.1 Designator#859.1 Designator#860.1 Designator#861.1 Designator#862.1 Designator#863.1 Designator#864.1 Designator#865.1 Designator#866.1 Designator#867.1 Designator#868.1 Designator#869.1 Designator#870.1 Designator#871.1 Designator#872.1 Designator#873.1 Designator#874.1 Designator#875.1 Designator#876.4 Designator#877.11 Designator#877.18 Designator#877.20 Designator#877.25 Designator#878.11 Designator#878.18 Designator#878.20 Designator#878.25 Designator#879.4 Designator#880.11 Designator#880.18 Designator#880.20 Designator#880.25 Designator#881.11 Designator#881.18 Designator#881.20 Designator#881.25 Designator#882.11 Designator#882.18 Designator#882.20 Designator#882.25 Designator#883.11 Designator#883.18 Designator#883.20 Designator#883.25 Designator#884.4 Designator#885.3 Designator#885.5 Designator#885.21 Designator#885.33 Designator#886.11 Designator#886.18 Designator#886.20 Designator#886.25 Designator#887.4 Designator#888.11 Designator#888.18 Designator#888.20 Designator#888.25 Designator#889.3 Designator#889.5 Designator#889.21 Designator#889.33 Designator#890.11 Designator#890.18 Designator#890.20 Designator#890.25 Designator#891.4 Designator#892.3 Designator#892.5 Designator#892.21 Designator#892.33 Designator#893.4 Designator#894.4 Designator#895.3 Designator#895.5 Designator#895.21 Designator#895.33 Designator#896.3 Designator#896.5 Designator#896.21 Designator#896.33 Designator#897.11 Designator#897.18 Designator#897.20 Designator#897.25 Designator#898.4 Designator#899.4 Designator#900.11 Designator#900.18 Designator#900.20 Designator#900.25 Designator#901.11 Designator#901.18 Designator#901.20 Designator#901.25 Designator#902.3 Designator#902.5 Designator#902.21 Designator#902.33 Designator#903.3 Designator#903.5 Designator#903.21 Designator#903.33 Designator#904.3 Designator#904.5 Designator#904.21 Designator#904.33 Designator#905.4 Designator#906.3 Designator#906.5 Designator#906.21 Designator#906.33 Designator#907.4 Designator#908.4 Designator#909.11 Designator#909.18 Designator#909.20 Designator#909.25 Designator#910.3 